# EasyEDA Pro project rckid3_devboard.eprj, board RCKid (continued)
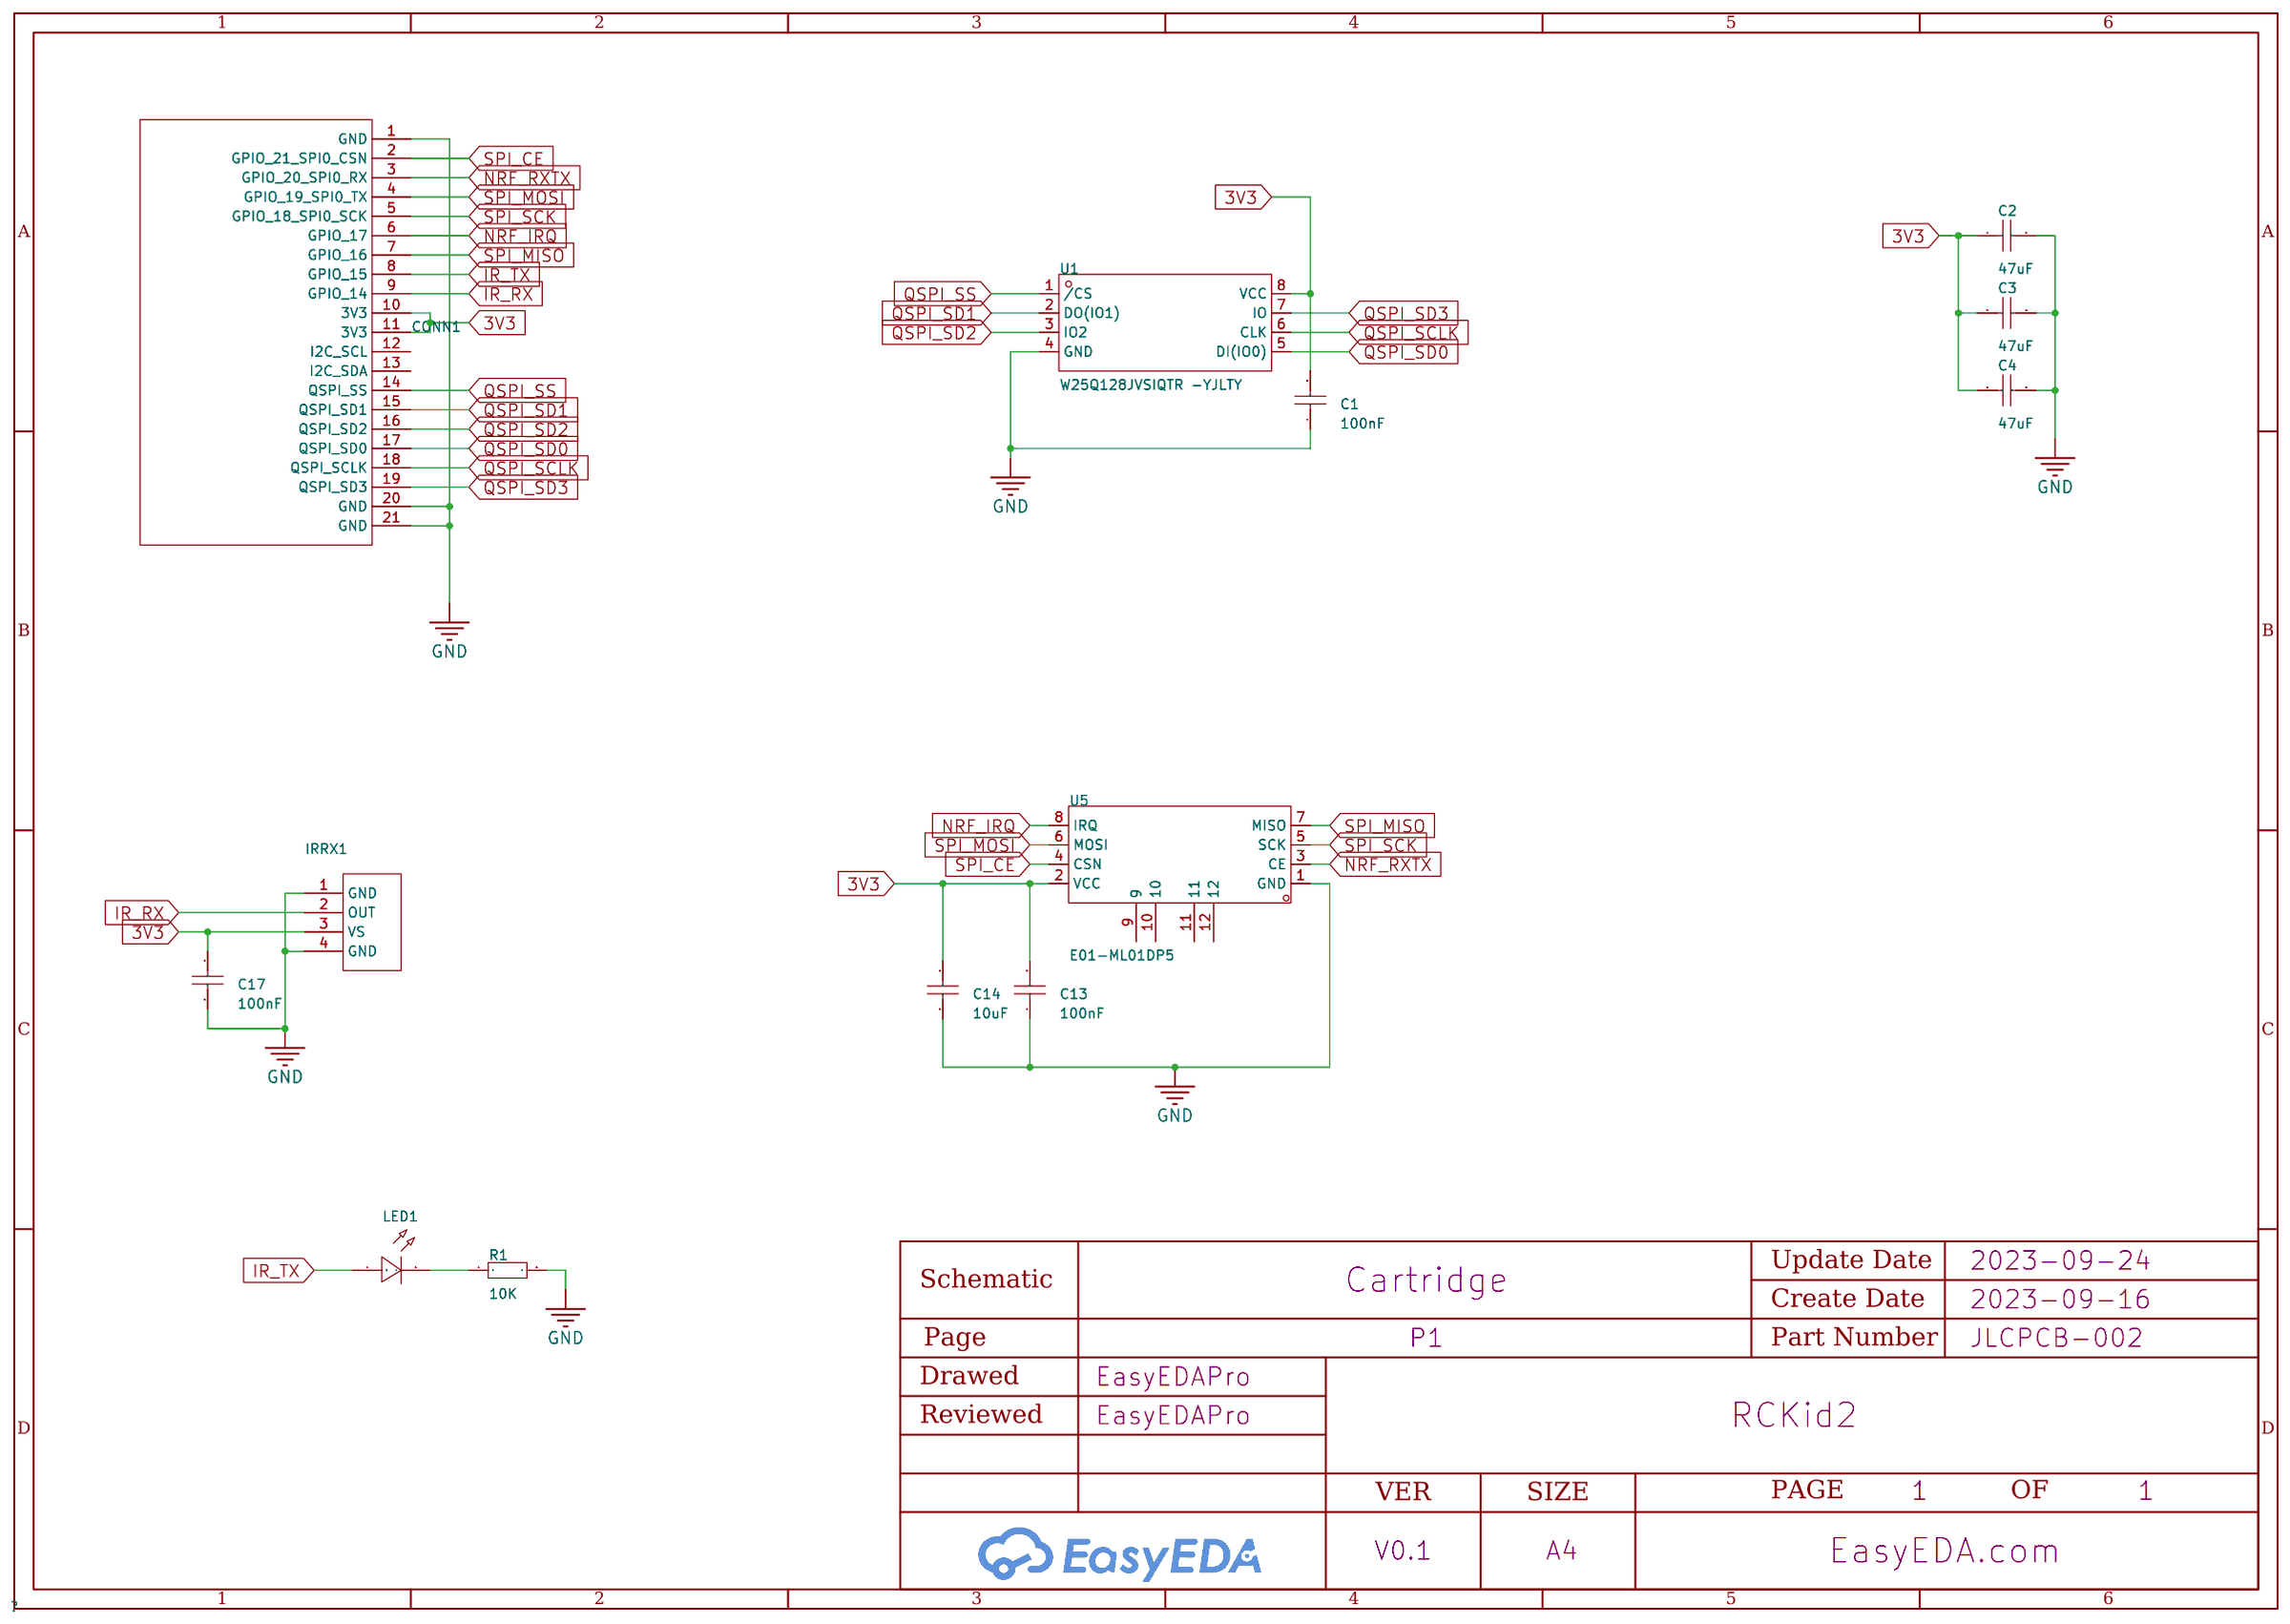
[diagram p0: NRF24L01P]
## Routing (per net, layer and track width the routed paths; a pad name or vN(x,y) marks a point on that pad's centre or on a via; arc(x,y) is an arc through that point) (continued)
MIC_N: length 6.7
  Top Layer w0.15: AUDIO.13 71.05,34.24 69.9,33.09 C206.1
MIC_P: length 4.5
  Top Layer w0.15: 71.7,30.44 71.9,30.44 71.9,33.19 72.45,33.74 AUDIO.14
PWM_BACKLIGHT: length 37.9
  Top Layer w0.15: 48.25,50.22 48.25,51.44 v1(47.9,51.79)
  Top Layer w0.2: v1(61.5,69.89) 68.3,69.89 69.4,70.99 R92.2
  Bottom Layer w0.15: v1(61.5,69.89) 56.4,64.79 56.4,60.09 55.8,59.49 50.5,59.49 47.9,56.89 v1(47.9,51.79)
PWM_RUMBLER: length 3.8
  Top Layer w0.15: 49.3,42.82 48.25,43.87 AVR.2
PWR_INT: length 48.1
  Top Layer w0.15: AVR.1 47.75,43.44 48.2,42.99 48.2,42.89 ; 47.7,43.49 45.2,43.49 44.1,42.39 42.8,42.39 v1(42.4,41.99) ; v1(35.7,23.69) v1(34.3,25.09) ; PWR.7 28.61,20.29 28.7,20.29 v1(28.7,19.69)
  Bottom Layer w0.15: v1(35.7,23.69) 36.7,22.69 36.7,18.69 R127.2 R126.1 ; v1(42.4,41.99) 42.4,33.19 v1(34.3,25.09) 29.9,20.69 29.9,20.09 29.5,19.69 v1(28.7,19.69)
QSPI_SCLK: length 16.3
  Top Layer w0.15: CARTRIDGE.19 29.8,61.01 29.8,61.89 arc(29.89,62.1) 30.1,62.19 30.3,62.19 arc(30.6,62.49) 30.3,62.79 30.1,62.79 arc(29.8,63.09) 30.1,63.39 30.3,63.39 arc(30.6,63.69) 30.3,63.99 30.1,63.99 arc(29.89,64.08) 29.8,64.29 29.8,64.79 31.4,66.39 31.4,70.09 30.4,71.09 RP2350B.71
QSPI_SD0: length 16.3
  Top Layer w0.15: RP2350B.72 30.8,71.39 32.32,69.87 32.32,65.49 arc(32.41,65.28) 32.62,65.19 32.7,65.19 arc(33,64.89) 32.7,64.59 32.62,64.59 arc(32.32,64.29) 32.62,63.99 32.7,63.99 arc(33,63.69) 32.7,63.39 32.62,63.39 arc(32.32,63.09) 32.62,62.79 32.7,62.79 arc(33,62.49) 32.7,62.19 32.62,62.19 arc(32.41,62.1) 32.32,61.89 CARTRIDGE.18
QSPI_SD1: length 16.4
  Top Layer w0.15: CARTRIDGE.16 37.4,61.89 arc(37.49,62.1) 37.7,62.19 37.8,62.19 arc(38.1,62.49) 37.8,62.79 37.7,62.79 arc(37.49,62.88) 37.4,63.09 37.4,66.19 31.6,71.99 RP2350B.74
QSPI_SD2: length 16.5
  Top Layer w0.15: CARTRIDGE.17 34.86,61.89 arc(34.95,62.1) 35.16,62.19 35.3,62.19 arc(35.6,62.49) 35.3,62.79 35.16,62.79 arc(34.86,63.09) 35.16,63.39 35.3,63.39 arc(35.6,63.69) 35.3,63.99 35.16,63.99 arc(34.95,64.08) 34.86,64.29 34.86,68.03 31.2,71.69 RP2350B.73
QSPI_SD3: length 16.3
  Top Layer w0.15: RP2350B.70 30,70.79 30.9,69.89 30.9,66.99 27.2,63.29 27.2,62.99 arc(27.29,62.78) 27.5,62.69 27.8,62.69 arc(28.1,62.39) 27.8,62.09 27.5,62.09 arc(27.29,62) 27.2,61.79 27.2,61.03 CARTRIDGE.20
QSPI_SS: length 33.9
  Top Layer w0.15: 47.75,50.22 47.75,50.84 47.4,51.19 44.3,51.19 43.5,51.99 v1(43.5,54.69) ; RP2350B.75 32,72.29 39.94,64.35 CARTRIDGE.15 39.94,59.38 40,59.32
  Bottom Layer w0.15: v1(43.5,54.69) 43.5,57.43 CARTRIDGE.15
RADIO_INT: length 82.1
  Top Layer w0.15: RP2350B.1 35.11,74.88 38.5,71.49 38.5,68.99 44,63.49 44,59.69 47.2,56.49 50,56.49 50.4,56.09 63.4,56.09 66.3,53.19 66.3,41.69 68.3,39.69 v1(68.3,28.59) ; v1(70.2,18.89) 70.74,18.35 RADIO.18
  Bottom Layer w0.15: v1(70.2,18.89) 70.2,19.89 TP4.1 68.3,22.09 v1(68.3,28.59)
RADIO_L: length 3.4
  Top Layer w0.15: 72.7,30.44 72.7,31.29 72.5,31.49 72.5,32.99 72.75,33.24 AUDIO.15
RADIO_R: length 2.5
  Top Layer w0.15: 73.7,30.44 73.7,31.09 73.17,31.62 AUDIO.16
RADIO_RESET: length 90.4
  Top Layer w0.15: RP2350B.79 33.6,73.44 33.75,73.29 34.7,73.29 37.6,70.39 37.6,69.04 43.6,63.04 43.6,59.19 46.9,55.89 49.7,55.89 50.1,55.49 63.1,55.49 65.7,52.89 65.7,41.39 67.7,39.39 v1(67.7,29.49) ; RADIO.5 74.02,15.87 v1(74.3,15.59) ; v1(69.6,15.09) 68.2,16.49 v1(68.2,20.79)
  Bottom Layer w0.15: v1(68.2,20.79) 67.7,21.29 v1(67.7,29.49) ; v1(69.6,15.09) 70,14.69 73.8,14.69 74.3,15.19 v1(74.3,15.59)
RGB: length 5.1
  Top Layer w0.15: U33.3 53.45,44.44 52.3,45.59 52.3,46.59 51.95,46.94 51.02,46.94
RPI_SWCLK: length 26.7
  Top Layer w0.15: RP2350B.33 29.2,85.49 v1(28.7,85.99)
  Bottom Layer w0.15: v1(28.7,85.99) 20.1,85.99 19,84.89 19,72.9 17.4,71.3
RPI_SWD: length 25.4
  Top Layer w0.15: v1(28,86.89) 28,85.69 28.8,84.89 RP2350B.34
  Bottom Layer w0.15: 17.4,73.84 17.4,84.19 20.1,86.89 v1(28,86.89)
SD_CSN: length 80.6
  Top Layer w0.15: RP2350B.56 24.4,76.79 23.5,75.89 18.6,75.89 17,77.49 17,89.79 17.2,89.99 17.2,96.59 21.6,100.99 50.3,100.99 50.6,100.69 62.7,100.69 64,99.39 L15.2
SD_RX: length 78.2
  Top Layer w0.15: L15.3 63.6,98.89 62.5,99.99 50.4,99.99 49.8,100.59 22,100.59 17.8,96.39 17.8,89.79 17.4,89.39 17.4,77.79 18.9,76.29 23.3,76.29 24.2,77.19 RP2350B.55
SD_SCK: length 73.4
  Top Layer w0.15: RP2350B.53 23.87,77.99 22.97,77.09 19.5,77.09 18.2,78.39 18.2,88.59 19,89.39 19,95.99 22.8,99.79 48.8,99.79 50,98.59 62.1,98.59 62.8,97.89 L15.5
SD_TX: length 75.8
  Top Layer w0.15: L15.4 63.2,98.39 62.3,99.29 50.2,99.29 49.3,100.19 22.4,100.19 18.4,96.19 18.4,89.59 17.8,88.99 17.8,78.09 19.2,76.69 23.13,76.69 24.03,77.59 RP2350B.54
SDIO_1: length 71
  Top Layer w0.15: RP2350B.52 23.7,78.39 22.8,77.49 19.8,77.49 18.6,78.69 18.6,88.19 19.6,89.19 19.6,95.79 23.2,99.39 48.3,99.39 49.8,97.89 61.9,97.89 62.4,97.39 L15.6
SDIO_2: length 83
  Top Layer w0.15: RP2350B.57 24.57,76.39 23.67,75.49 18.3,75.49 16.6,77.19 16.6,96.79 21.2,101.39 62.9,101.39 64.4,99.89 L15.1
SPEAKER_EN: length 12.2
  Top Layer w0.15: 79.7,27.19 v1(80.3,27.79) ; v1(78.1,37.09) 78.03,37.02 AUDIO.32
  Bottom Layer w0.15: v1(80.3,27.79) 80.3,28.39 80,28.69 80,35.59 78.5,37.09 v1(78.1,37.09)
SPEAKER_N: length 2.9
  Top Layer w0.15: AUDIO.22 76.35,31.34 76.7,30.99 77.3,30.99 77.7,30.59 R105.1
SPEAKER_P: length 3.3
  Top Layer w0.15: AUDIO.23 76.85,31.54 77,31.39 77.8,31.39 78.7,30.49 R106.1
SPI0_CSN_GPIO_21:
  vias: v1(-9.5,74.59)
SPI0_RX_GPIO_20:
  vias: v1(-7,74.59)
SPI0_SCK_GPIO_18:
  vias: v1(-1.9,74.59)
SPI0_TX_GPIO_19:
  vias: v1(-4.4,74.59)
UPDI: length 37.4
  Top Layer w0.15: v1(28.8,58.19) 30.1,58.19 40.85,47.44 AVR.23 46.92,47.49
  Bottom Layer w0.15: v1(28.8,58.19) 25.5,58.19 17.44,66.25 DEBUG.2
USB_DM: length 72.6
  Top Layer w0.15: v1(29.1,10.79) 29.1,10.39 28.95,10.24 USB.A7
  Top Layer w0.154: R50.1 28,66.89 28.3,66.59 28.3,66.22 25.99,63.92 25.99,55.72 16.89,46.62 16.89,18.26 22.87,12.29 27.47,12.29 28.1,11.66 v1(28.1,11.29) 28.1,10.79 27.95,10.64 USB.B7
  Bottom Layer w0.15: v1(29.1,10.79) 28.6,11.29 v1(28.1,11.29)
USB_DP: length 72.9
  Top Layer w0.154: USB.A6 28.45,10.84 28.9,11.29 ; USB.B6 29.4,9.61 29.4,10.39 29.6,10.59 29.6,10.99 29.3,11.29 28.9,11.29 ; 28.9,11.29 27.59,12.6 22.99,12.6 17.2,18.39 17.2,46.49 26.3,55.59 26.3,63.79 29.2,66.69 R51.1
VUSB: length 16.5
  Top Layer w0.25: 25.35,17.79 25.45,17.89 PWR.1
  Top Layer w0.5: v1(26.6,11.49) 26.3,11.19 USB.B9A4 ; USB.A9B4 v1(31.1,10.59) v1(31.1,11.19)
  Bottom Layer w0.5: R52.2 v1(27.6,14.29) 28.47,14.29 D16.2 v1(28.5,15.19) ; v1(31.1,10.59) v1(31.1,11.19) v1(30.6,11.69) v1(30.1,12.19) v1(29,12.19) 27.3,12.19 v1(26.6,11.49)
  Bottom Layer w0.7: Q8.1 29.65,14.54 29.43,14.32 D16.2
  vias: v1(29.4,14.29)
XIN: length 10.3
  Top Layer w0.2: U39.1 31.35,92.84 30.5,91.99 30.5,90.35 C153.1 30.6,88.74 30.6,86.87 30.4,86.67 RP2350B.30
XOUT: length 3.4
  Top Layer w0.2: RP2350B.31 30,87.26
$1N1000: length 4.5
  Top Layer w0.5: 5V.4 47.1,25.69 45,25.69 44.3,24.99 C83.1
$1N1001: length 4.5
  Top Layer w0.5: C83.2 44.3,22.99 45,22.29 47.1,22.29 5V.6
$1N63321: length 0.5
  Top Layer w0.15: PWR.2 PWR.3
$1N63464: length 6.5
  Top Layer w0.25: PWR.22 24.78,21.29 20.45,21.29 19.64,20.49 19.53,20.38 19.53,19.49
$1N63621: length 4.3
  Top Layer w0.15: 30.5,18.49 29.9,18.49 29.6,18.79 29.6,20.99 29.3,21.29 PWR.9
$1N63731: length 3.5
  Top Layer w0.25: C215.2 22.95,20.54 23.55,20.54 23.8,20.79 24.78,20.79 PWR.23
  Top Layer w0.5: C215.2 22.8,19.09
$1N64929: length 5.2
  Top Layer w0.25: 19.6,21.95 19.75,21.79 PWR.21
$1N65109: length 5.6
  Top Layer w0.15: 30.5,16.72 30.33,16.89 29.6,16.89 29.2,17.29 29.2,20.69 29.1,20.79 PWR.8
$1N65541: length 13.5
  Top Layer w0.15: R113.1 18.63,18.59 v1(20.4,18.59) ; 28.6,22.29 v1(29.6,22.29)
  Bottom Layer w0.15: v1(20.4,18.59) 20.5,18.59 23.4,21.49 28.8,21.49 v1(29.6,22.29)
$1N65681: length 2
  Top Layer w0.15: PWR.10 29.4,21.79 29.6,21.59 30.35,21.59 30.5,21.74 30.5,21.74
$1N67269: length 1.9
  Top Layer w0.27: 43.2,32.59 43.2,33.79 42.7,34.29
$1N67295: length 4.2
  Top Layer w0.15: 43.9,28.49 43.9,29.49 44,29.59 44,30.29 43.7,30.59 43.7,31.39 ; 43.9,29.59 42.8,29.59
$1N67403: length 4.3
  Top Layer w0.15: 52.8,36.39 54,36.39 ; 54,36.39 54,35.29 ; 54,36.39 54,37.19 53.7,37.49 53.7,38.29
$1N67445: length 1.7
  Top Layer w0.27: 52.8,40.89 53.2,40.49 53.2,39.39
$1N73932: length 22.3
  Bottom Layer w0.7: Q8.2 29.55,16.44 29.33,16.66 D16.1 25.27,16.66 24.7,16.09 21.5,16.09 19.5,18.09 19.5,27.96 AAA_PWR.1
$1N75550: length 2.5
  Top Layer w0.15: v1(29.3,22.89) 29.2,22.79 28.6,22.79
  Bottom Layer w0.15: TP1.1 30.7,23.59 30,22.89 v1(29.3,22.89)
$2N19576: length 11.7
  Top Layer w0.15: R76.2 66.53,87.69 66.9,87.69 v1(67.4,88.19) 67.9,87.69 microSD.7 ; L15.14 63.6,93.59 v1(64,93.19)
  Bottom Layer w0.15: v1(67.4,88.19) 67.4,89.79 v1(64,93.19)
$2N25545: length 5.2
  Top Layer w0.15: microSD.1 65.1,94.29 64.4,94.99 L15.16
$2N25554: length 6.6
  Top Layer w0.15: L15.15 64,94.14 64.95,93.19 65.1,93.19 microSD.2
$2N25581: length 8.4
  Top Layer w0.15: L15.13 63.2,93.19 64.3,92.09 microSD.3
$2N25588: length 11
  Top Layer w0.15: microSD.5 63.8,89.89 62.8,90.89 L15.12
$2N25598: length 14
  Top Layer w0.15: L15.11 62.4,88.79 64.6,86.59 microSD.8
$2N27404: length 2.2
  Top Layer w0.15: R120.1 39.2,53.99 39.75,53.44 U40.7
$2N27409: length 2
  Top Layer w0.15: U40.9 40.56,51.23 40.8,50.99 40.8,50.62 R119.1
$3N64809: length 1.8
  Top Layer w0.15: AUDIO.18 74.35,31.14 74.7,30.79 74.7,30.44
$3N64814: length 2.6
  Top Layer w0.15: AUDIO.24 77.93,32.06 78.6,31.39 79.66,31.39 79.7,31.44
$3N64820: length 2.4
  Top Layer w0.25: AUDIO.29 79.35,34.74 80.1,35.49 80.1,35.55
$3N65040: length 3
  Top Layer w0.15: AUDIO.1 77.35,37.64 v1(77.6,37.89)
  Bottom Layer w0.15: v1(77.6,37.89) 77.1,37.39 TP3.1
$3N65354: length 12.8
  Top Layer w0.15: v1(69.1,27.39) 61.3,27.39 ; v1(71.9,28.29) 71.9,29.05 71.79,29.16 70.9,29.16
  Bottom Layer w0.15: v1(71.9,28.29) 71,27.39 v1(69.1,27.39)
$3N65358: length 11.9
  Top Layer w0.15: 61.3,26.69 69.48,26.69 69.9,27.11 69.9,27.14 ; 69.9,27.14 70.35,26.69 70.77,26.69 R104.2 ; 69.9,27.14 69.9,29.05
$3N65820: length 3.5
  Top Layer w0.15: 77.7,29.19 77.7,26.39 78.2,25.89
$3N66044: length 2.9
  Top Layer w0.25: 74.2,7.49 C200.1
$3N66054: length 3.1
  Top Layer w0.25: C199.1 63.09,11.19 65.51,11.19 HEADSET.4
$3N66059: length 10.7
  Top Layer w0.25: 74.2,4.79 74.49,5.09 L18.1 76.9,5.19 77.8,6.09 78.3,6.09 78.7,6.49 78.7,9.19 78.14,9.75 C242.1
$3N66555: length 3.1
  Top Layer w0.15: 78.8,26.29 78.5,26.59 78.5,27.79 78.7,27.99 78.7,29.19
$3N66592: length 8.5
  Top Layer w0.25: SPEAKER.1 83.7,22.59 83.7,23.99 83.1,24.59 82.2,24.59 81.8,24.99
$3N66597: length 3.5
  Top Layer w0.25: 78.5,20.99 78.5,21.09 80,22.59 80,23.29 80.4,23.69
$3N73775: length 7.7
  Top Layer w0.25: 74.55,23.79 74.9,23.45 C238.1 75.8,22.89 76.1,22.59 76.1,18.99 75.46,18.35 RADIO.9
$3N73781: length 6.4
  Top Layer w0.25: 72.05,23.79 72,23.74 72,21.69 71.45,21.15 C239.2 71,19.09 71.24,18.85 RADIO.17
$3N73999: length 10.2
  Top Layer w0.15: v1(73.7,25.69) 73.77,25.76 73.77,25.99 73.87,26.09 73.87,28.98 ; 73.9,29.05 73.87,29.01 73.87,28.98 ; 73.87,28.98 73.8,29.05 73.7,29.05 ; v1(73.7,20.29) 73.52,20.11 73.52,19.5
  Bottom Layer w0.15: v1(73.7,20.29) 74.09,20.68 74.09,25.3 v1(73.7,25.69)
$3N74004: length 10.3
  Top Layer w0.15: v1(72.8,20.29) 73.02,20.07 73.02,19.5 ; 72.9,28.95 72.9,29.05 ; 72.9,28.95 72.8,29.05 72.7,29.05 ; 72.9,28.95 72.9,26.06 72.83,25.99 72.83,25.72 v1(72.8,25.69)
  Bottom Layer w0.15: v1(72.8,25.69) 72.37,25.26 72.37,20.72 v1(72.8,20.29)
$3N78093: length 7.2
  Top Layer w0.15: v1(68.9,17.19) 69.56,17.85 RADIO.19
  Bottom Layer w0.15: TP5.1 66.8,17.19 v1(68.9,17.19)
$4N10766: length 24.8
  Top Layer w0.15: v1(39.5,27.69) 39.45,27.69 35.55,31.59 32.8,31.59 RIGHT1.1 ; 45.9,20.56 45.83,20.49 v1(45.1,20.49)
  Top Layer w0.2: RIGHT1.3 RIGHT1.1
  Bottom Layer w0.15: v1(45.1,20.49) 41.7,23.89 41.7,25.49 v1(39.5,27.69)
$4N10774: length 41.7
  Top Layer w0.15: 40.3,27.69 35.3,32.69 27.5,32.69 21.7,38.49 TOP1.1 ; 47.5,20.39 47.44,20.45 v1(46.84,20.45)
  Top Layer w0.2: TOP1.3 TOP1.1
  Bottom Layer w0.15: v1(40.3,27.69) 42.3,25.69 42.3,24.99 v1(46.84,20.45)
$4N10782: length 45.2
  Top Layer w0.15: v1(40.3,28.49) 40.3,28.54 36.7,32.14 36.7,48.69 33.9,51.49 LEFT1.3 ; 49.3,20.59 49.2,20.49 v1(48.5,20.49)
  Top Layer w0.2: LEFT1.3 LEFT1.1
  Bottom Layer w0.15: v1(48.5,20.49) 46.2,22.79 46,22.79 v1(40.3,28.49)
$4N10794: length 31.1
  Top Layer w0.15: BOTTOM1.3 37.99,36.78 37.99,31.7 v1(41.1,28.59) ; v1(50.2,20.49) 50.9,20.49
  Top Layer w0.2: BOTTOM1.3 BOTTOM1.1
  Bottom Layer w0.15: v1(50.2,20.49) 47.3,23.39 46.3,23.39 v1(41.1,28.59)
$4N10842: length 32.6
  Top Layer w0.15: D15.1 v1(62.6,49.59)
  Bottom Layer w0.15: v1(62.6,49.59) 69.3,49.59 73.6,45.29 73.6,42.89 80.6,35.89 80.6,31.29 VOL_DOWN.1
$4N10903: length 17.3
  Top Layer w0.15: B1.1 v1(72.2,49.49) ; v1(76.2,49.49) B1.3 ; D9.1 v1(62.6,51.29)
  Bottom Layer w0.15: v1(62.6,51.29) 70.4,51.29 v1(72.2,49.49) v1(76.2,49.49)
$4N10915: length 15.1
  Top Layer w0.15: A1.3 62.3,38.49 v1(61.7,39.09) 61.1,38.49 A1.1 ; D10.1 v1(60.6,46.19)
  Bottom Layer w0.15: v1(61.7,39.09) 60.6,40.19 v1(60.6,46.19)
$4N17155: length 24
  Top Layer w0.15: v1(72.7,47.09) v1(70.9,47.09) ; v1(62.6,47.89) D14.1
  Bottom Layer w0.15: v1(62.6,47.89) 69.8,47.89 70.6,47.09 v1(70.9,47.09) ; v1(72.7,47.09) 73.9,47.09 VOL_UP.1
$4N18597: length 11
  Top Layer w0.2: B3.1 B3.3 42.73,20.46 D12.1
$4N18613: length 15.7
  Top Layer w0.2: D11.1 52.7,20.59 56.4,24.29 58.95,24.29 60.2,23.04 B2.1 B2.3
$4N38253: length 1.7
  Top Layer w0.6: R84.2 Q6.3
$4N49584: length 19.7
  Top Layer w0.15: LED10.4 30.4,40.99 v1(30.4,33.89) 30.45,33.94 30.45,35.04
  Top Layer w0.2: v1(30.4,30.19) 34.35,26.24 LED11.1
  Bottom Layer w0.2: v1(30.4,30.19) v1(30.4,33.89)
$4N49861: length 28.8
  Top Layer w0.15: LED8.1 74.95,48.24 v1(72.3,45.59)
  Bottom Layer w0.15: v1(72.3,45.59) 71.5,44.79 65.7,44.79 62.4,41.49 v1(62.4,31.69)
$4N49881: length 10.6
  Top Layer w0.2: v1(58.9,21.49) 58.65,21.24 LED12.4
  Bottom Layer w0.2: v1(58.9,21.49) 64,26.59 v1(64,28.89)
$4N49891: length 23.6
  Top Layer w0.2: v1(38,24.39) 37.95,24.44 LED11.4 ; LED12.1 v1(56.3,18.99)
  Bottom Layer w0.2: v1(56.3,18.99) 55.1,17.79 44.6,17.79 v1(38,24.39)
$4N50022: length 2.8
  Top Layer w0.15: R87.1 57.3,44.39 U33.4
$4N50025: length 20.7
  Top Layer w0.15: LED8.4 73.45,53.24 v1(72.9,53.79) ; R87.2 62.5,44.39 63.5,45.39 63.5,51.69 v1(63.7,51.89)
  Bottom Layer w0.15: v1(63.7,51.89) 64,52.19 70.2,52.19 71,52.99 72.1,52.99 v1(72.9,53.79)
$4N50031: length 1.7
  Top Layer w0.2: LED10.1 27.32,41.94 R88.1
$4N56569: length 5.4
  Top Layer w0.5: RUMBLER.1 48,34.49
$4N56605: length 11
  Top Layer w0.15: Q9.1 50.35,33.54 48.3,35.59 48.3,39.99 49.3,40.99 49.3,41.79 50.33,41.79 50.5,41.96
$4N56656: length 3.2
  Top Layer w0.3: 70.7,72.86 70.68,72.84 Q6.1
$4N78796: length 24.7
  Top Layer w0.15: D17.1 v1(62.6,52.99)
  Bottom Layer w0.15: HOME1.2 80.5,63.49 70,52.99 v1(62.6,52.99)
$4N81859: length 4.9
  Top Layer w0.25: 50.25,50.22 50.27,50.19 50.9,50.19 51.35,50.64 X1.1 54.3,50.64 C232.2
$4N81864: length 6.9
  Top Layer w0.25: C233.2 54.3,53.14 X1.2 51.75,53.14 49.75,51.14 49.75,50.22
$6N10559: length 13.3
  Top Layer w0.2: v1(30.3,10.69) 30.45,10.54 USB.B5 ; R57.1 v1(21,7.99)
  Bottom Layer w0.2: v1(21,7.99) 21,8.59 22.9,10.49 24.7,10.49 25.3,9.89 29.5,9.89 v1(30.3,10.69)
$6N10563: length 11.5
  Top Layer w0.2: 19.8,7.32 v1(19.8,7.99) ; v1(27.4,10.69) 27.45,10.64 USB.A5
  Bottom Layer w0.2: v1(27.4,10.69) 26.3,10.69 25.7,11.29 22.3,11.29 19.8,8.79 v1(19.8,7.99)
$7N680: length 5.9
  Top Layer w0.154: RP2350B.67 28.8,68.72 29.2,68.32
$7N687: length 5.9
  Top Layer w0.154: 28,68.32 28.1,68.42 28.1,68.49 28.4,68.79 RP2350B.66
$7N1009: length 3.2
  Top Layer w0.2: 29.8,88.12 29.8,89.34 C154.1 29.64,90.9 U39.3

## Copper pours and planes (outline as drawn; the poured copper is in the pictures)
3V3 on Inner2: 44.7,34.99 46.7,34.99 47.7,35.99 47.7,40.99 48.2,41.49 48.2,42.49 49.2,43.49 51.2,43.49 53.2,45.49 53.2,46.49 52.7,46.99 46.2,46.99 45.2,47.99 45.2,51.99 44.7,52.49 38.7,52.49 38.2,51.99 38.2,51.49 41.7,47.99 41.7,43.99 44.7,40.99
5V on Inner2: 50.2,24.99 50.2,29.99 52.2,31.99 56.7,31.99 59.7,34.99 59.7,44.99 67.2,52.49 71.2,52.49 71.7,51.99 71.7,50.99 71.2,50.49 68.7,50.49 62.7,44.49 62.7,31.99 60.2,29.49 54.2,29.49 53.2,28.49 53.2,24.49 54.2,23.49 56.2,23.49 56.7,23.99 57.2,23.99 57.7,23.49 57.7,21.49 55.2,18.99 41.7,18.99 40.2,20.49 34.7,20.49 33.2,18.99 25.7,18.99 23.7,20.99 23.7,41.49 27.2,44.99 31.7,44.99 32.7,43.99 32.7,40.49 26.7,34.49 26.7,24.49 27.7,23.49 32.2,23.49 35.2,26.49 41.7,26.49 44.7,23.49 48.7,23.49
GND on Inner1: 5.9,121.69 92.1,121.69 92.1,-5.21 5.9,-5.21
VBATT on Top Layer: 31.2,21.99 30.2,22.99 27.2,22.99 27.2,23.99 27.4,24.19 33,24.19 33.7,23.49 33.7,17.49 39.7,14.99 39.7,8.49 36.7,8.49 36.7,9.49 31.2,14.99
VCC on Inner2: 26.7,24.49 26.7,26.99 33.2,33.49 46.7,33.49 48.7,35.49 48.7,39.99 49.2,40.49 50.2,40.49 50.7,39.99 50.7,32.99 48.7,30.99 48.7,26.49 49.2,25.99 49.2,23.99 48.7,23.49 44.7,23.49 41.7,26.49 35.2,26.49 32.2,23.49 27.7,23.49
IOVDD on Inner2: 22.7,86.49 57.3,86.49 64.5,93.69 70.7,93.69 71.6,92.79 71.6,67.79 80.7,58.49 80.7,32.49 81.7,31.49 81.7,26.99 84.2,26.99 84.2,20.99 75.2,20.99 73.7,22.49 73.7,37.49 72.7,38.49 72.7,39.49 73.7,40.49 73.7,51.99 72.7,52.99 65.7,52.99 58.7,45.99 58.7,36.49 54.7,32.49 52.2,32.49 51.7,32.99 51.7,33.49 55.7,37.5 55.7,40.49 53.7,42.49 53.7,53.49 35.8,71.49 22.7,71.49
VUSB on Top Layer: 31.7,12.49 31.7,10.99 28.7,10.99 28.7,11.99 26.7,13.99 25.2,13.99 24.9,14.29 24.9,19.49 25.3,19.89 25.6,19.89 25.6,18.59

## Text on the board
Bottom Silkscreen Layer: GND | SWD | SWC | ATX | UPDI | DBG|PGM | 47 | SD3 | SCLK | SD0 | SD2 | SD1 | SS | 3V3 | 11 | 12 | 13 | 14 | 15 | 16 | 17 | 18 | 19 | QSPI | GPIO|UART|SPI | + | - | USE AT YOUR OWN RISK. DO NOT CHARGE / UNATTENDED. DO NOT SHORT-CIRCUIT. DO / NOT INSERT OR REMOVE CARTRIDGES WHEN / POWERED ON. DC rating: 5V/1.5A. Charging / max 500mA, system 300mA, cartridge / 500mA. Operating temp: 0-40C | Li-Po: 3.7V, max size 503759. Min discharge / current 1.3A. USE PROTECTED CELLS ONLY!!! / AAA: 3x AAA Ni-Mh or Alkaline. DO NOT / SOLDER CHARGER WHEN AAA BATTERIES / ARE USED.
Top Silkscreen Layer: JLCJLCJLCJLC | RCKid mkIII Development Board
